# EasyEDA Pro project FPGA-G1.eprj, schematic Schematic1, sheets 1 to 6 of 10

## Sheets
1 FPGA: Board Name: Board1; Create Date: 2025-03-03; Page Name: FPGA; Project Name: FPGA-G1; Schematic Name: Schematic1; Update Date: 2025-03-06; Company: 嘉立创EDA; Page Size: A4; Version: V1.0
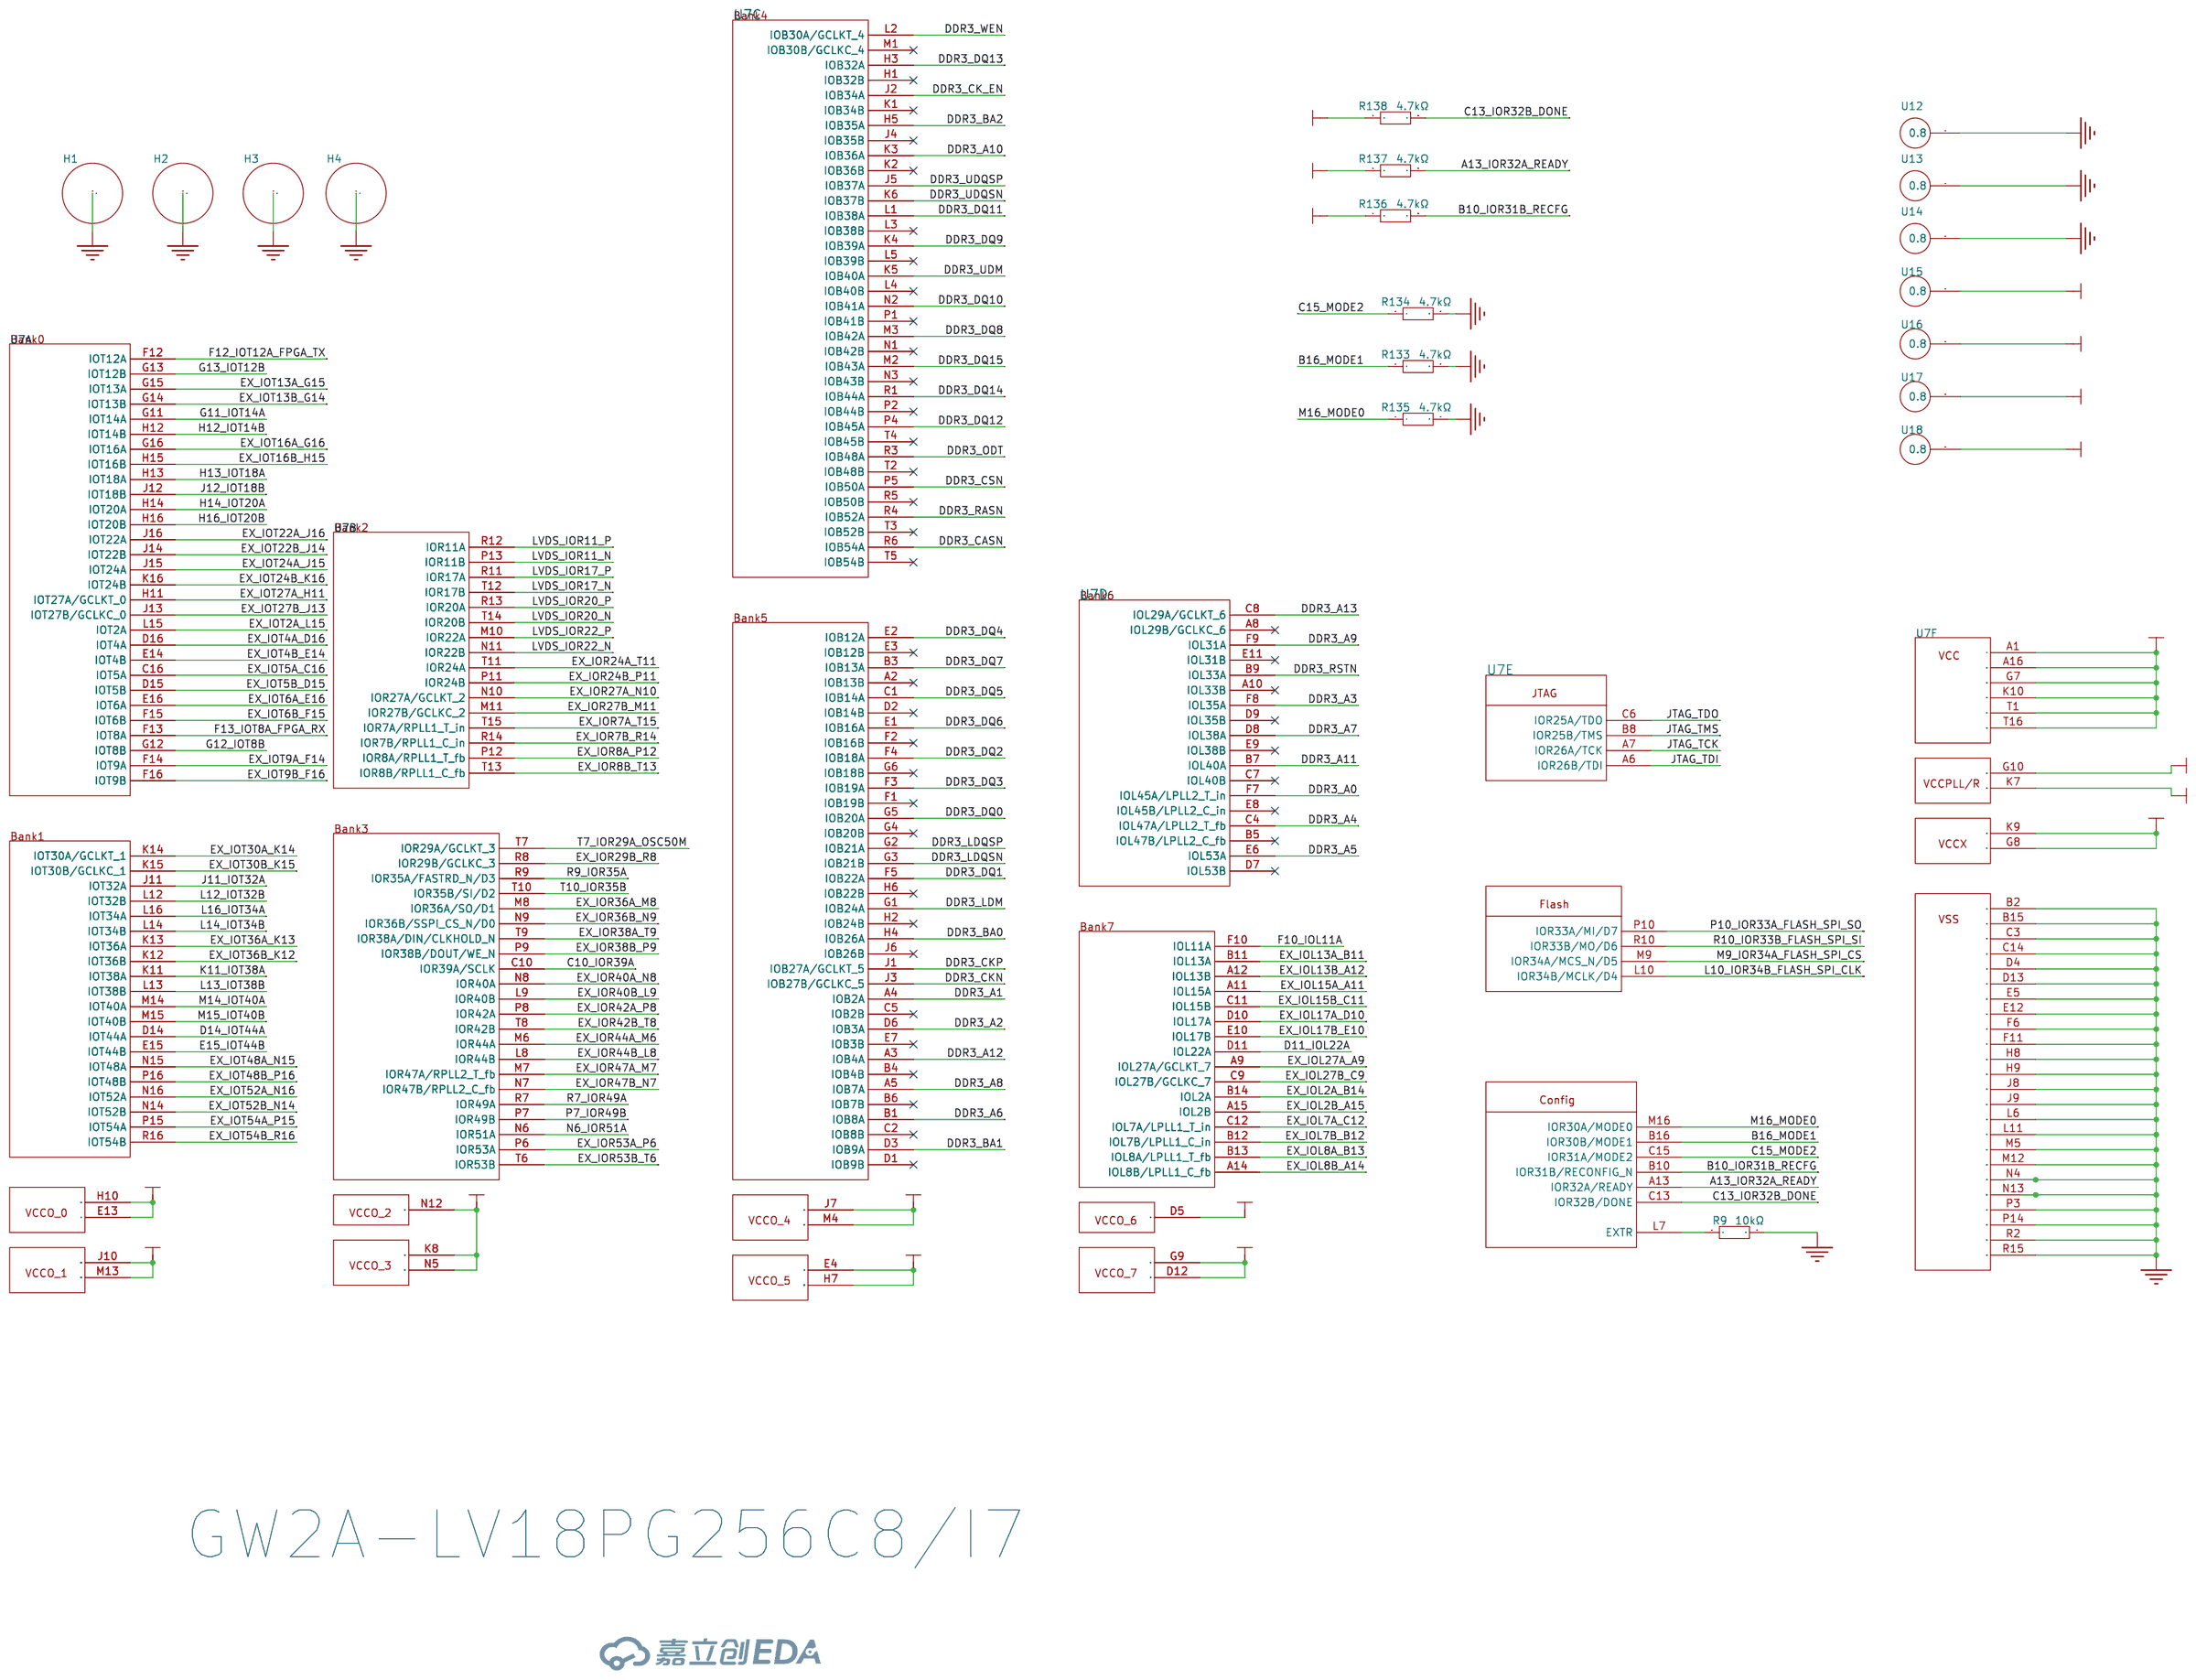
[diagram p0: FPGA]
2 FPGA_DDR3
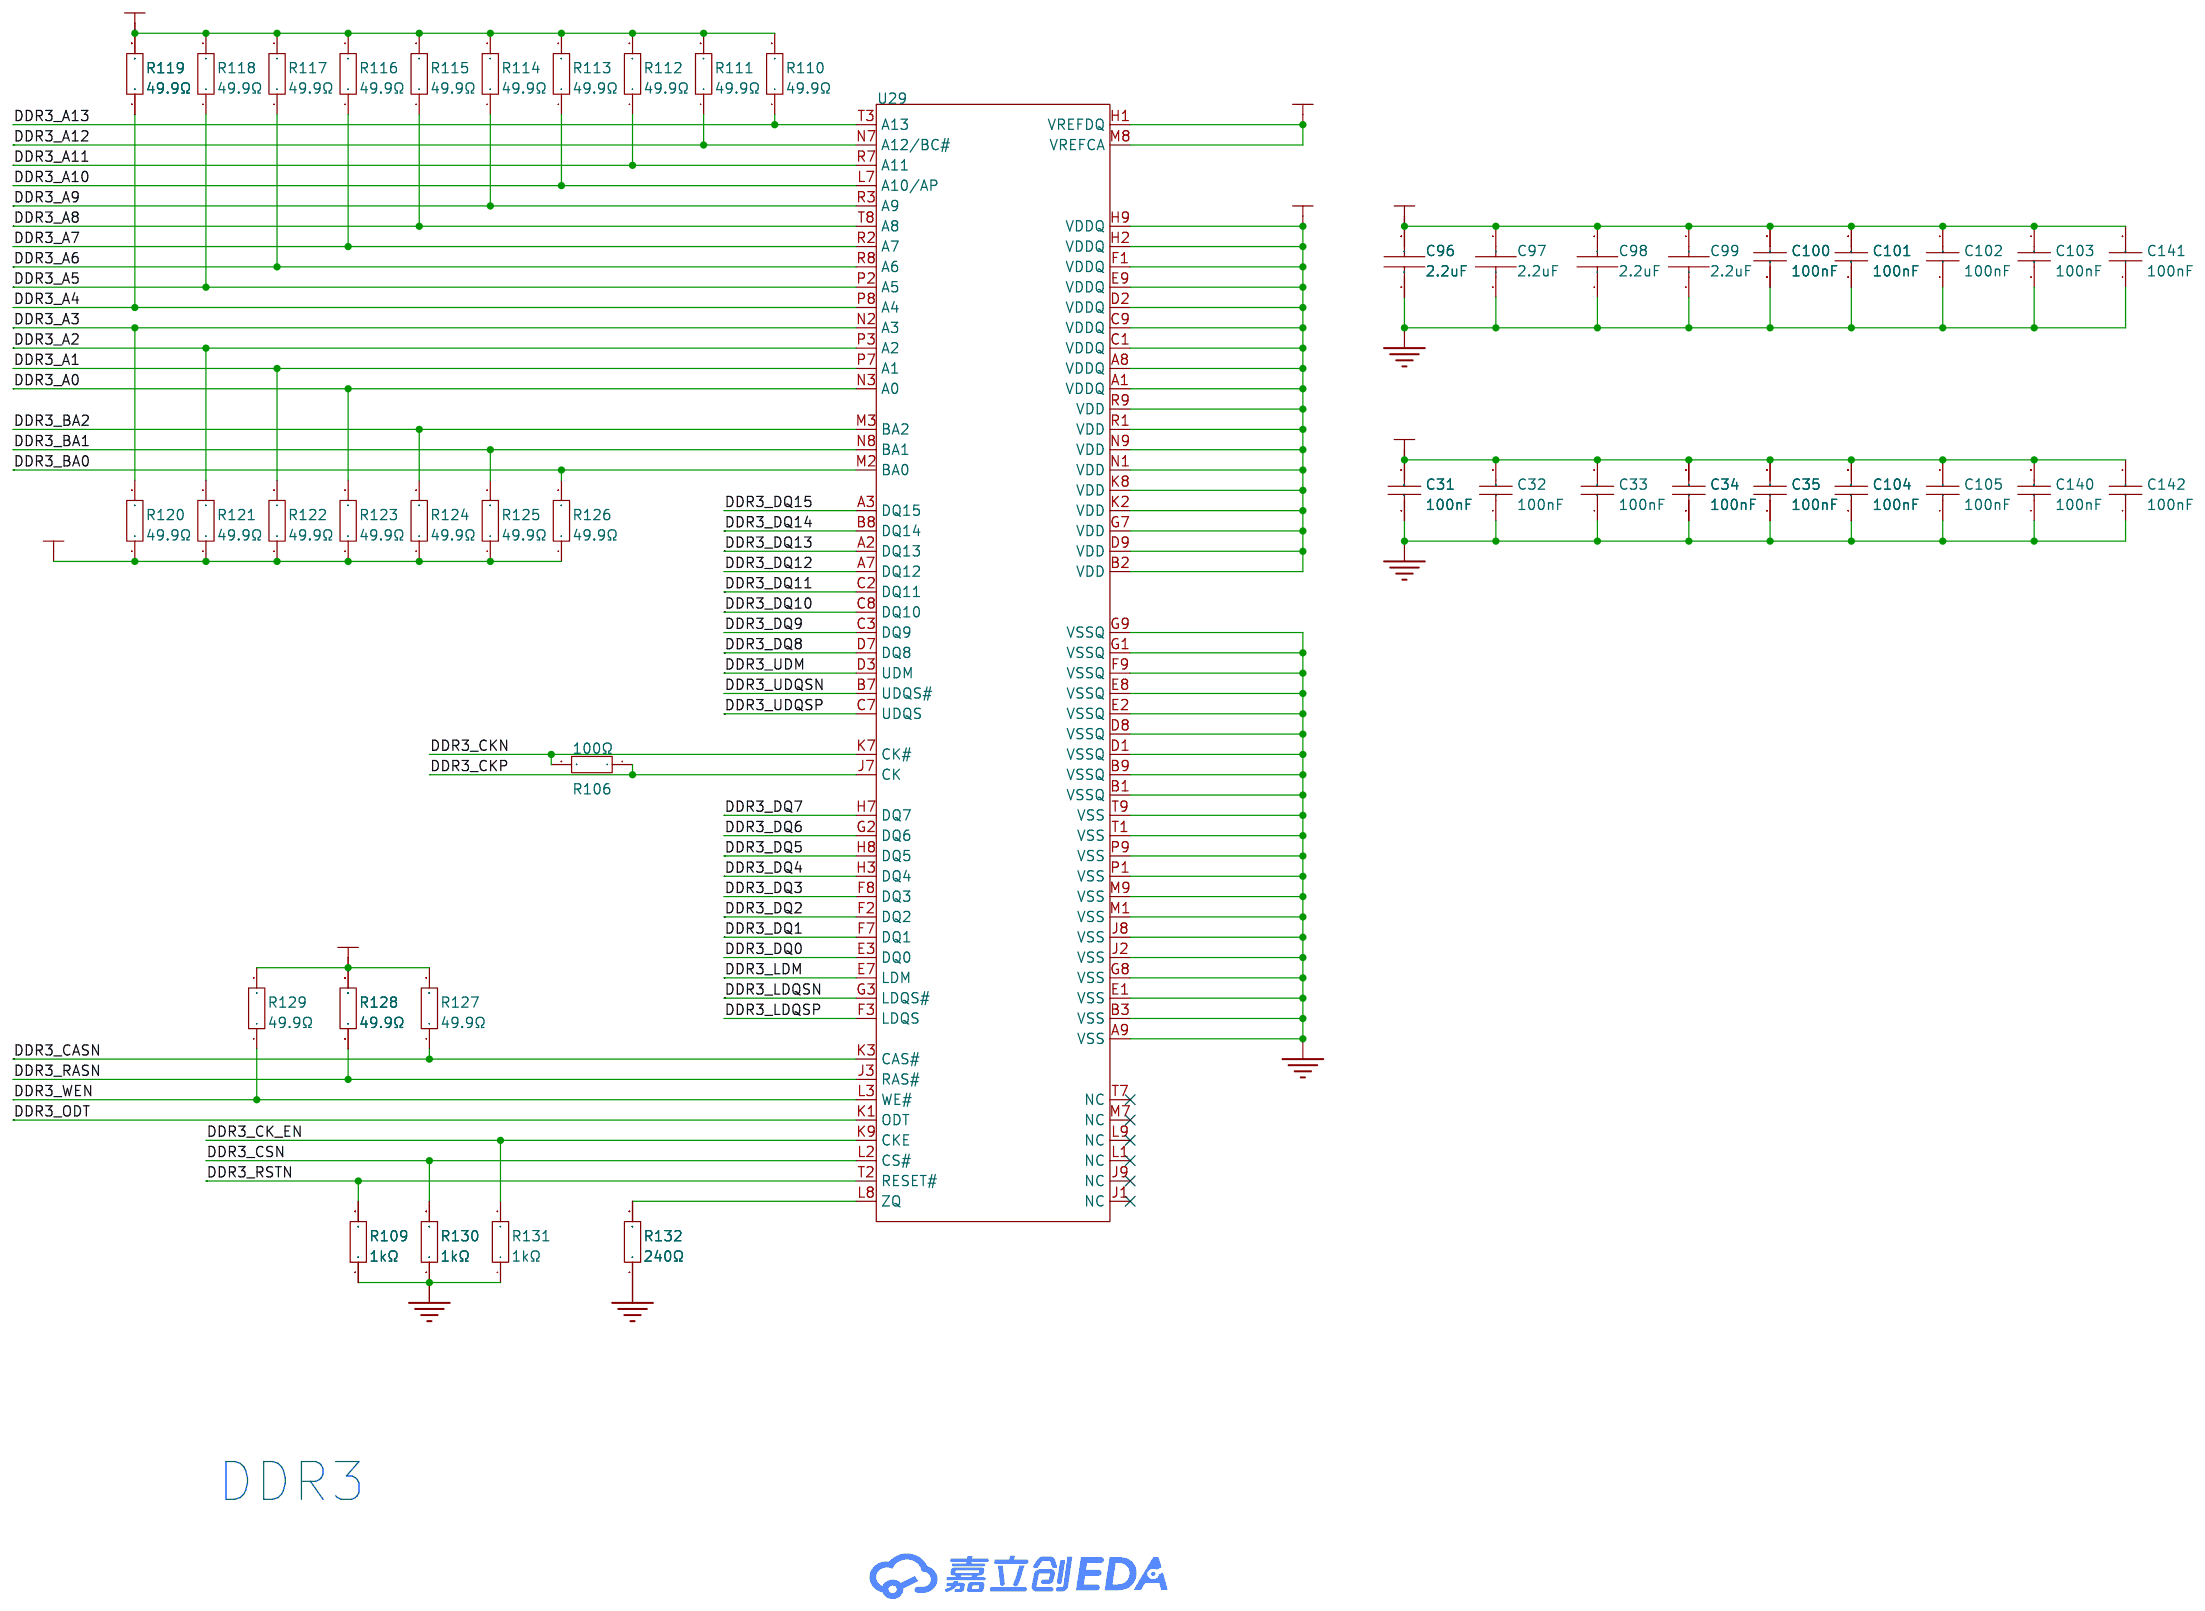
[diagram p1: FPGA_DDR3]
3 FPGA_DDR3_Power
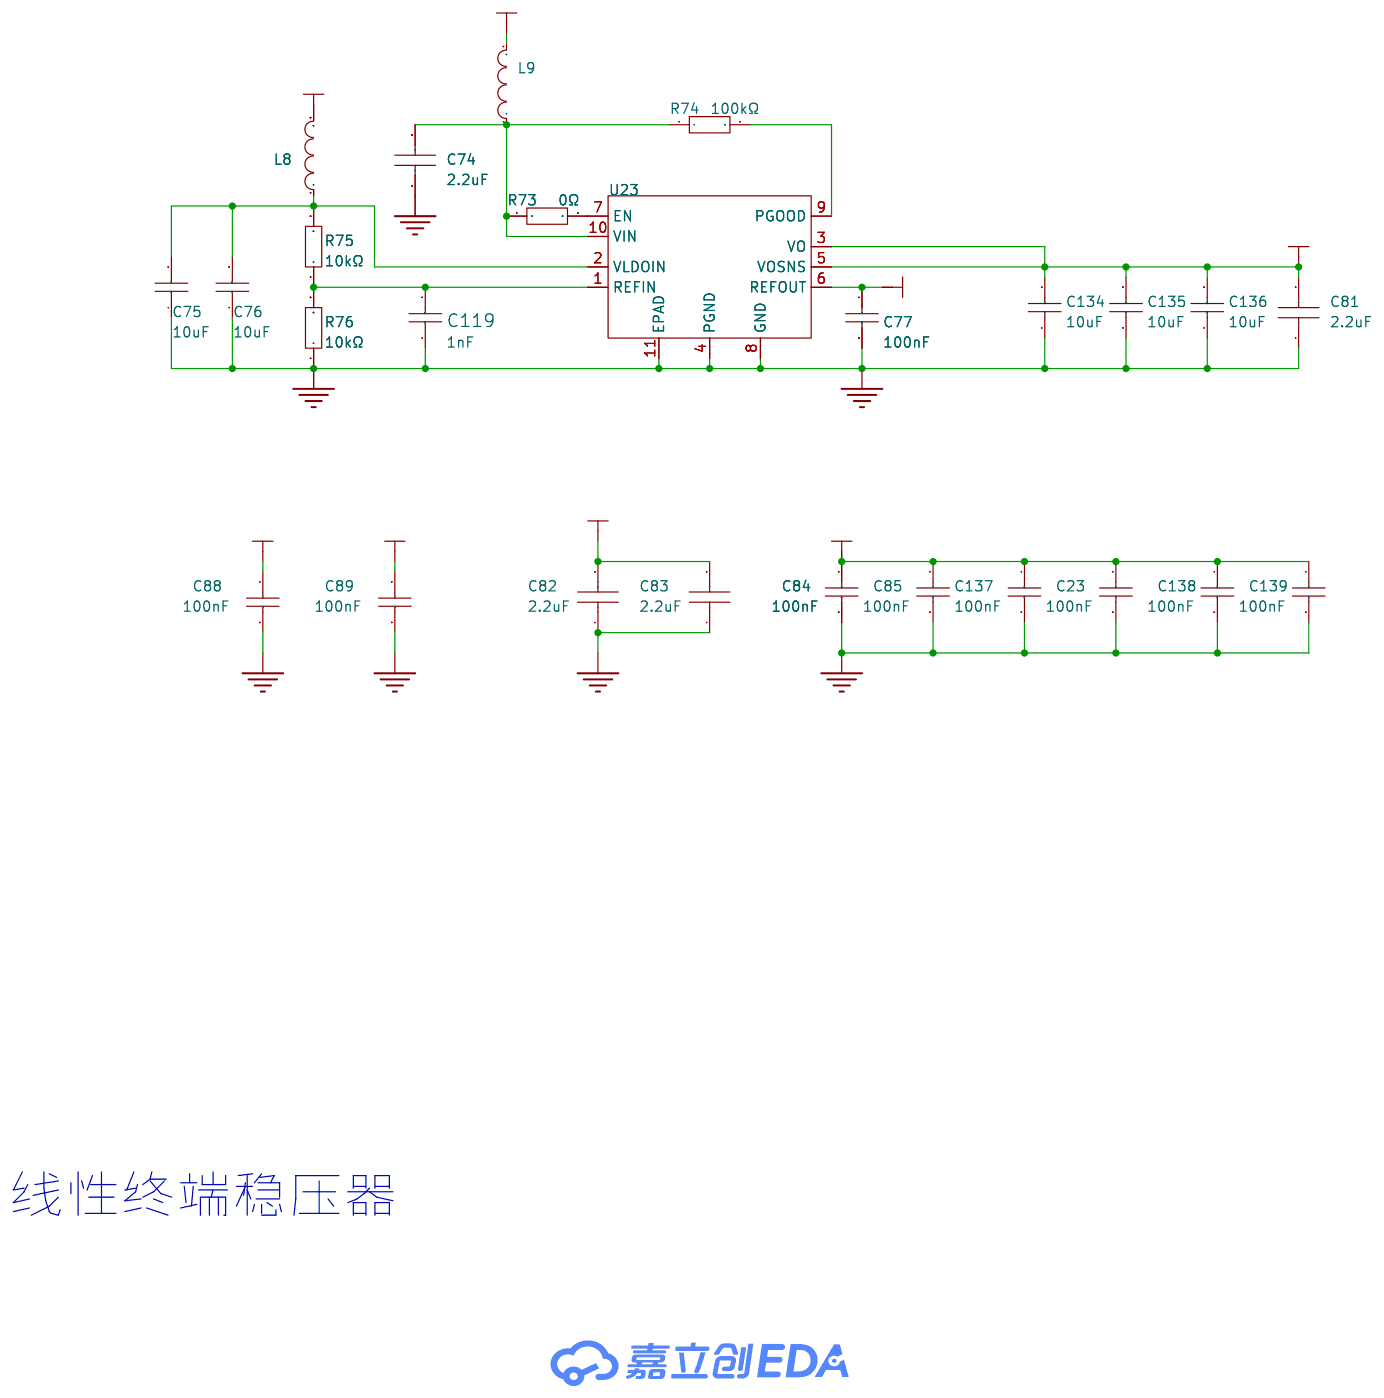
[diagram p2: FPGA_DDR3_Power]
4 FPGA_JTAG
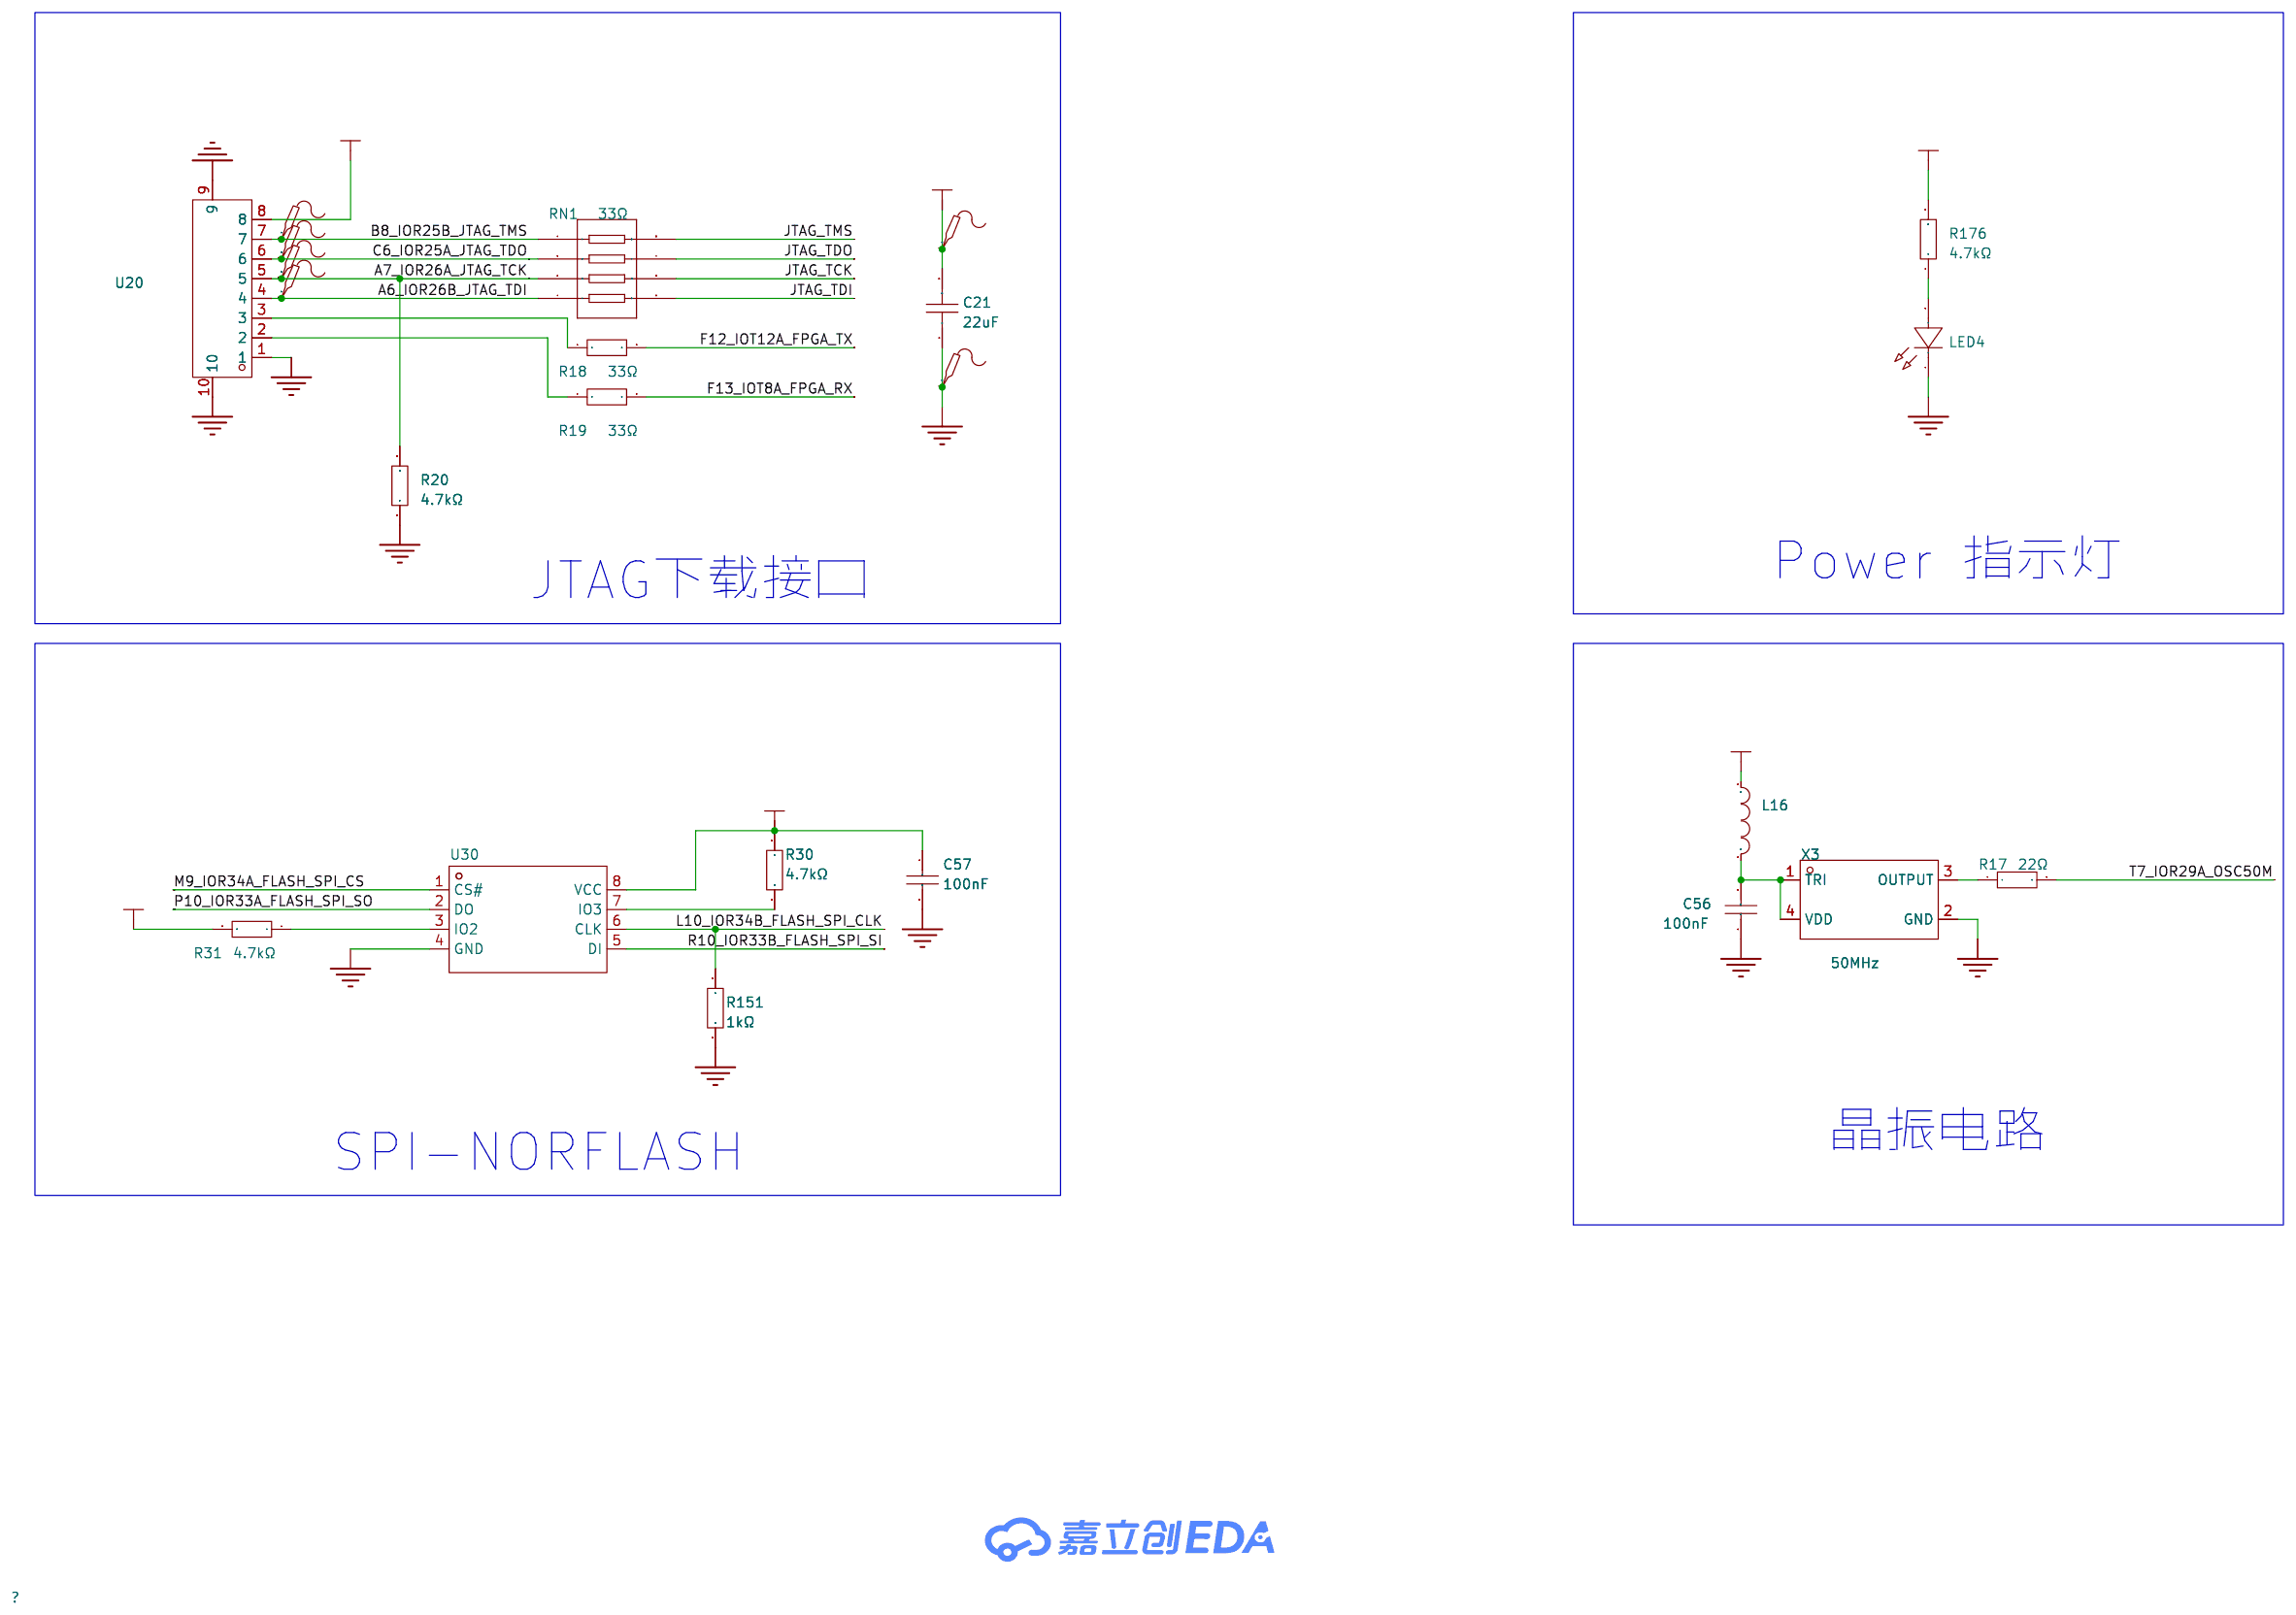
[diagram p3: FPGA_JTAG]
5 FPGA_HDMI: Page Name: FPGA_HDMI
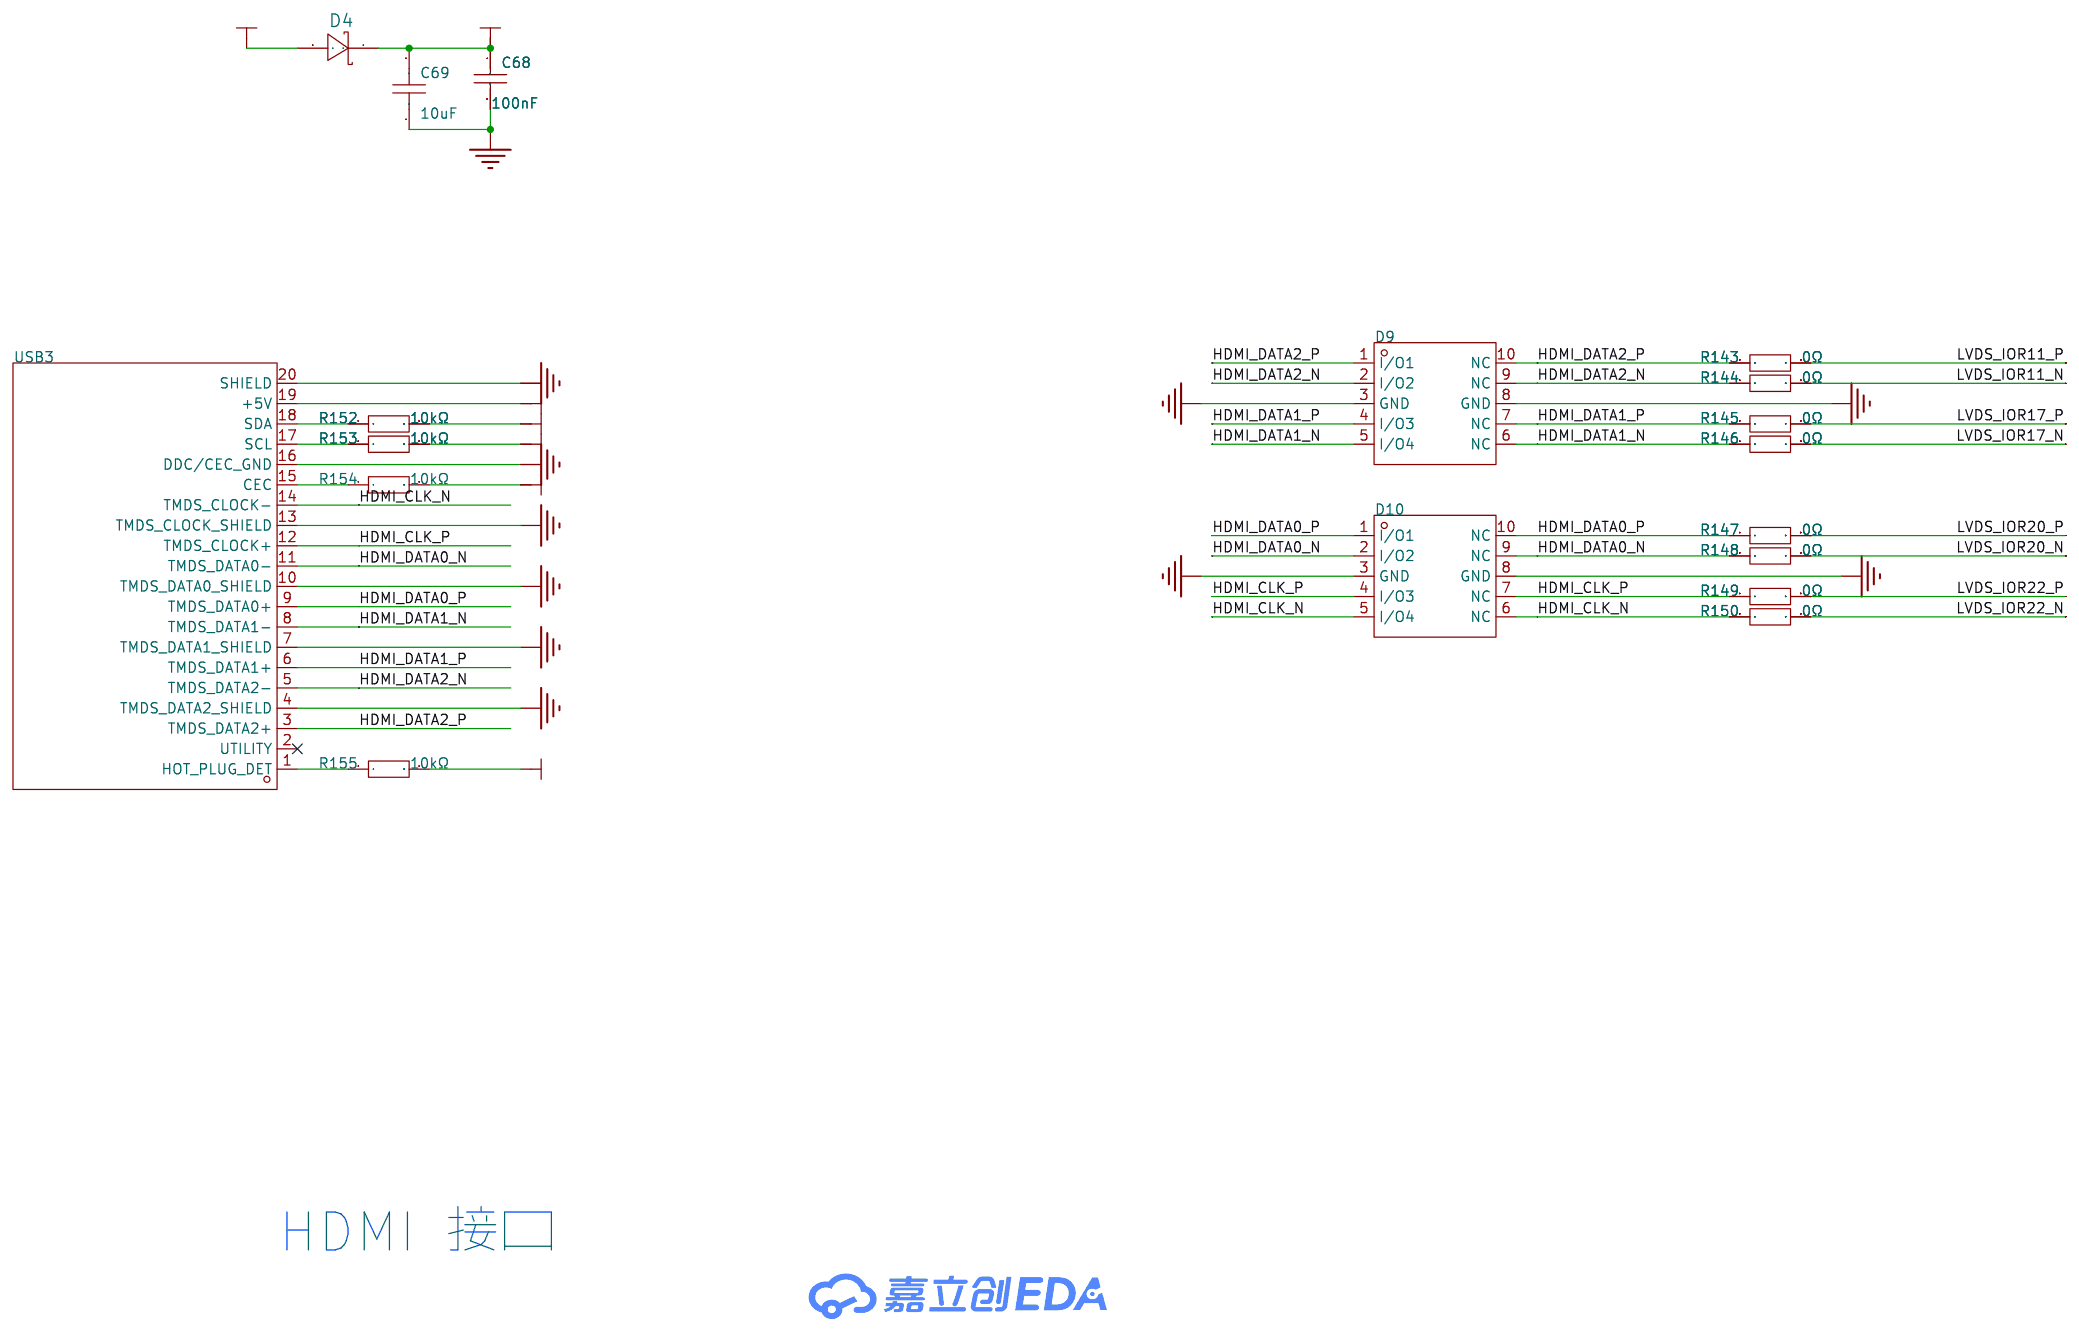
[diagram p4: FPGA_HDMI]
6 FPGA_Peripheral